# EasyEDA Pro project MushIO_V1p0_Final.eprj, schematic MushIO_V1p0_Final

## Sheets
1 Electrodes: Board Name: MushIO_V1p0_Final; Create Date: 2026-01-24; Page Name: Electrodes; Project Name: MushIO_V1p0_Final; Schematic Name: MushIO_V1p0_Final; Update Date: 2026-01-24; Company: EasyEDA.com; Page Size: A4; Version: V1.0
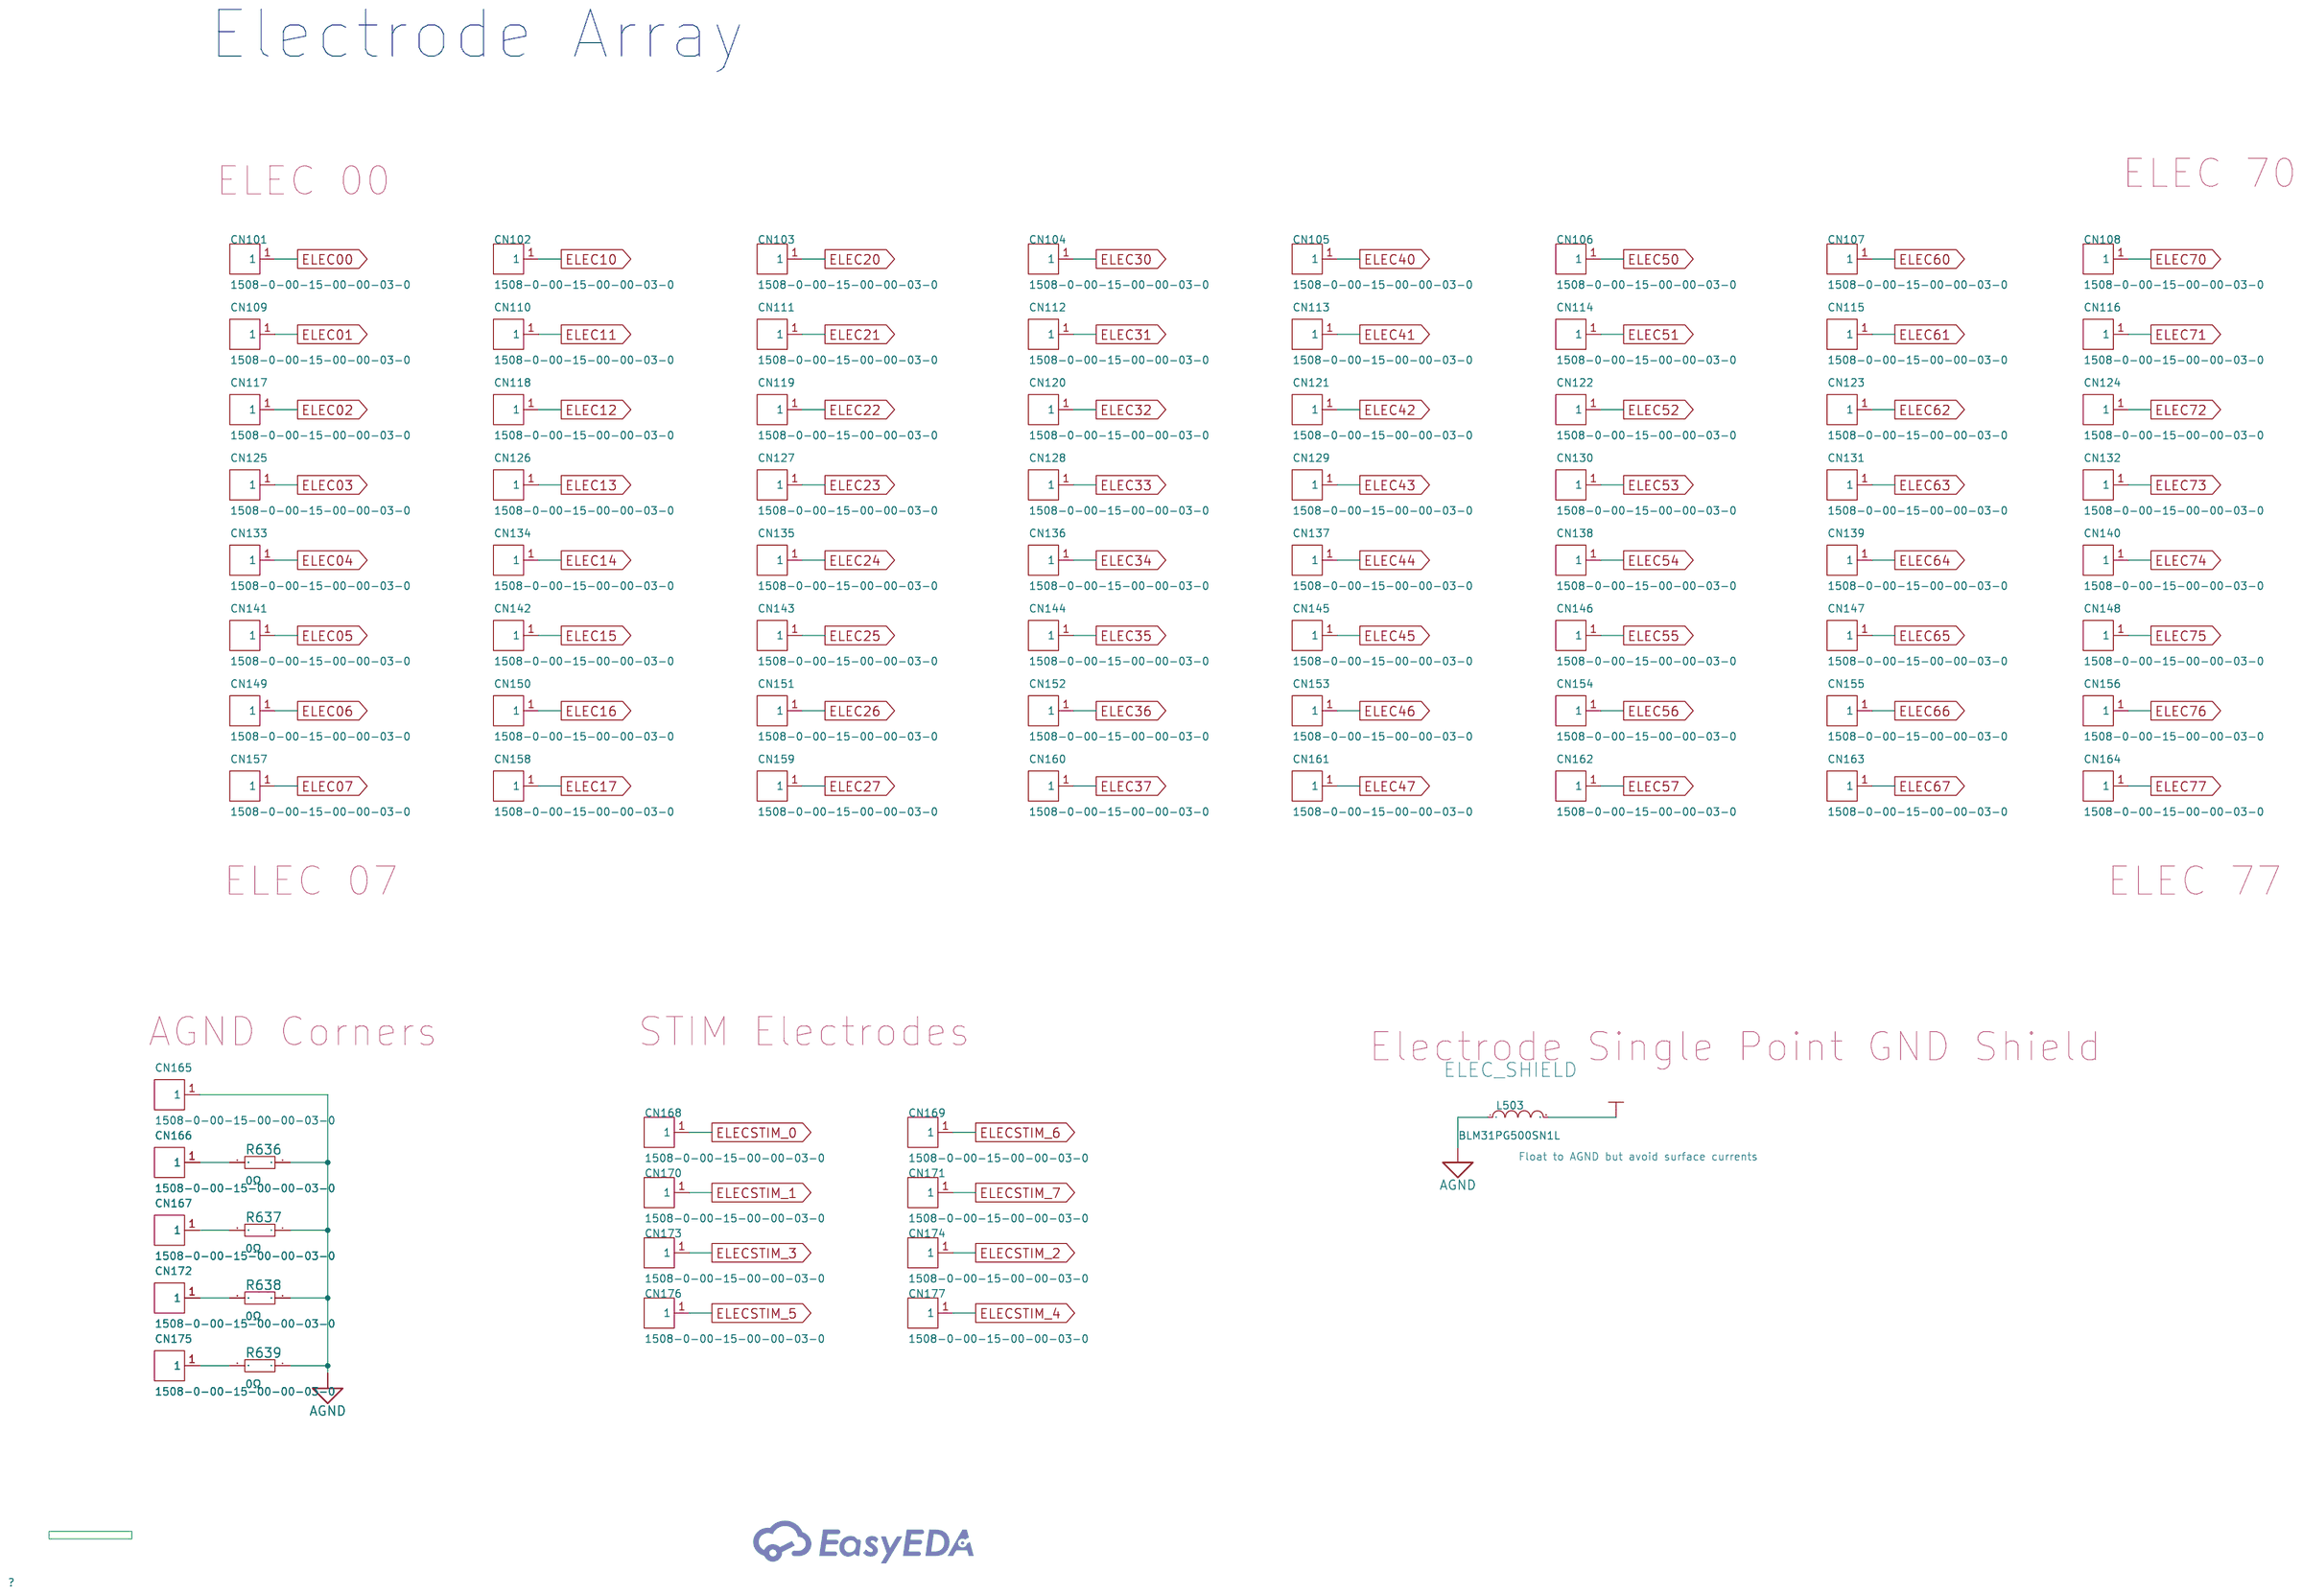
[diagram p2: Electrodes]
2 Power: Page Name: Power; Update Date: 2026-02-10
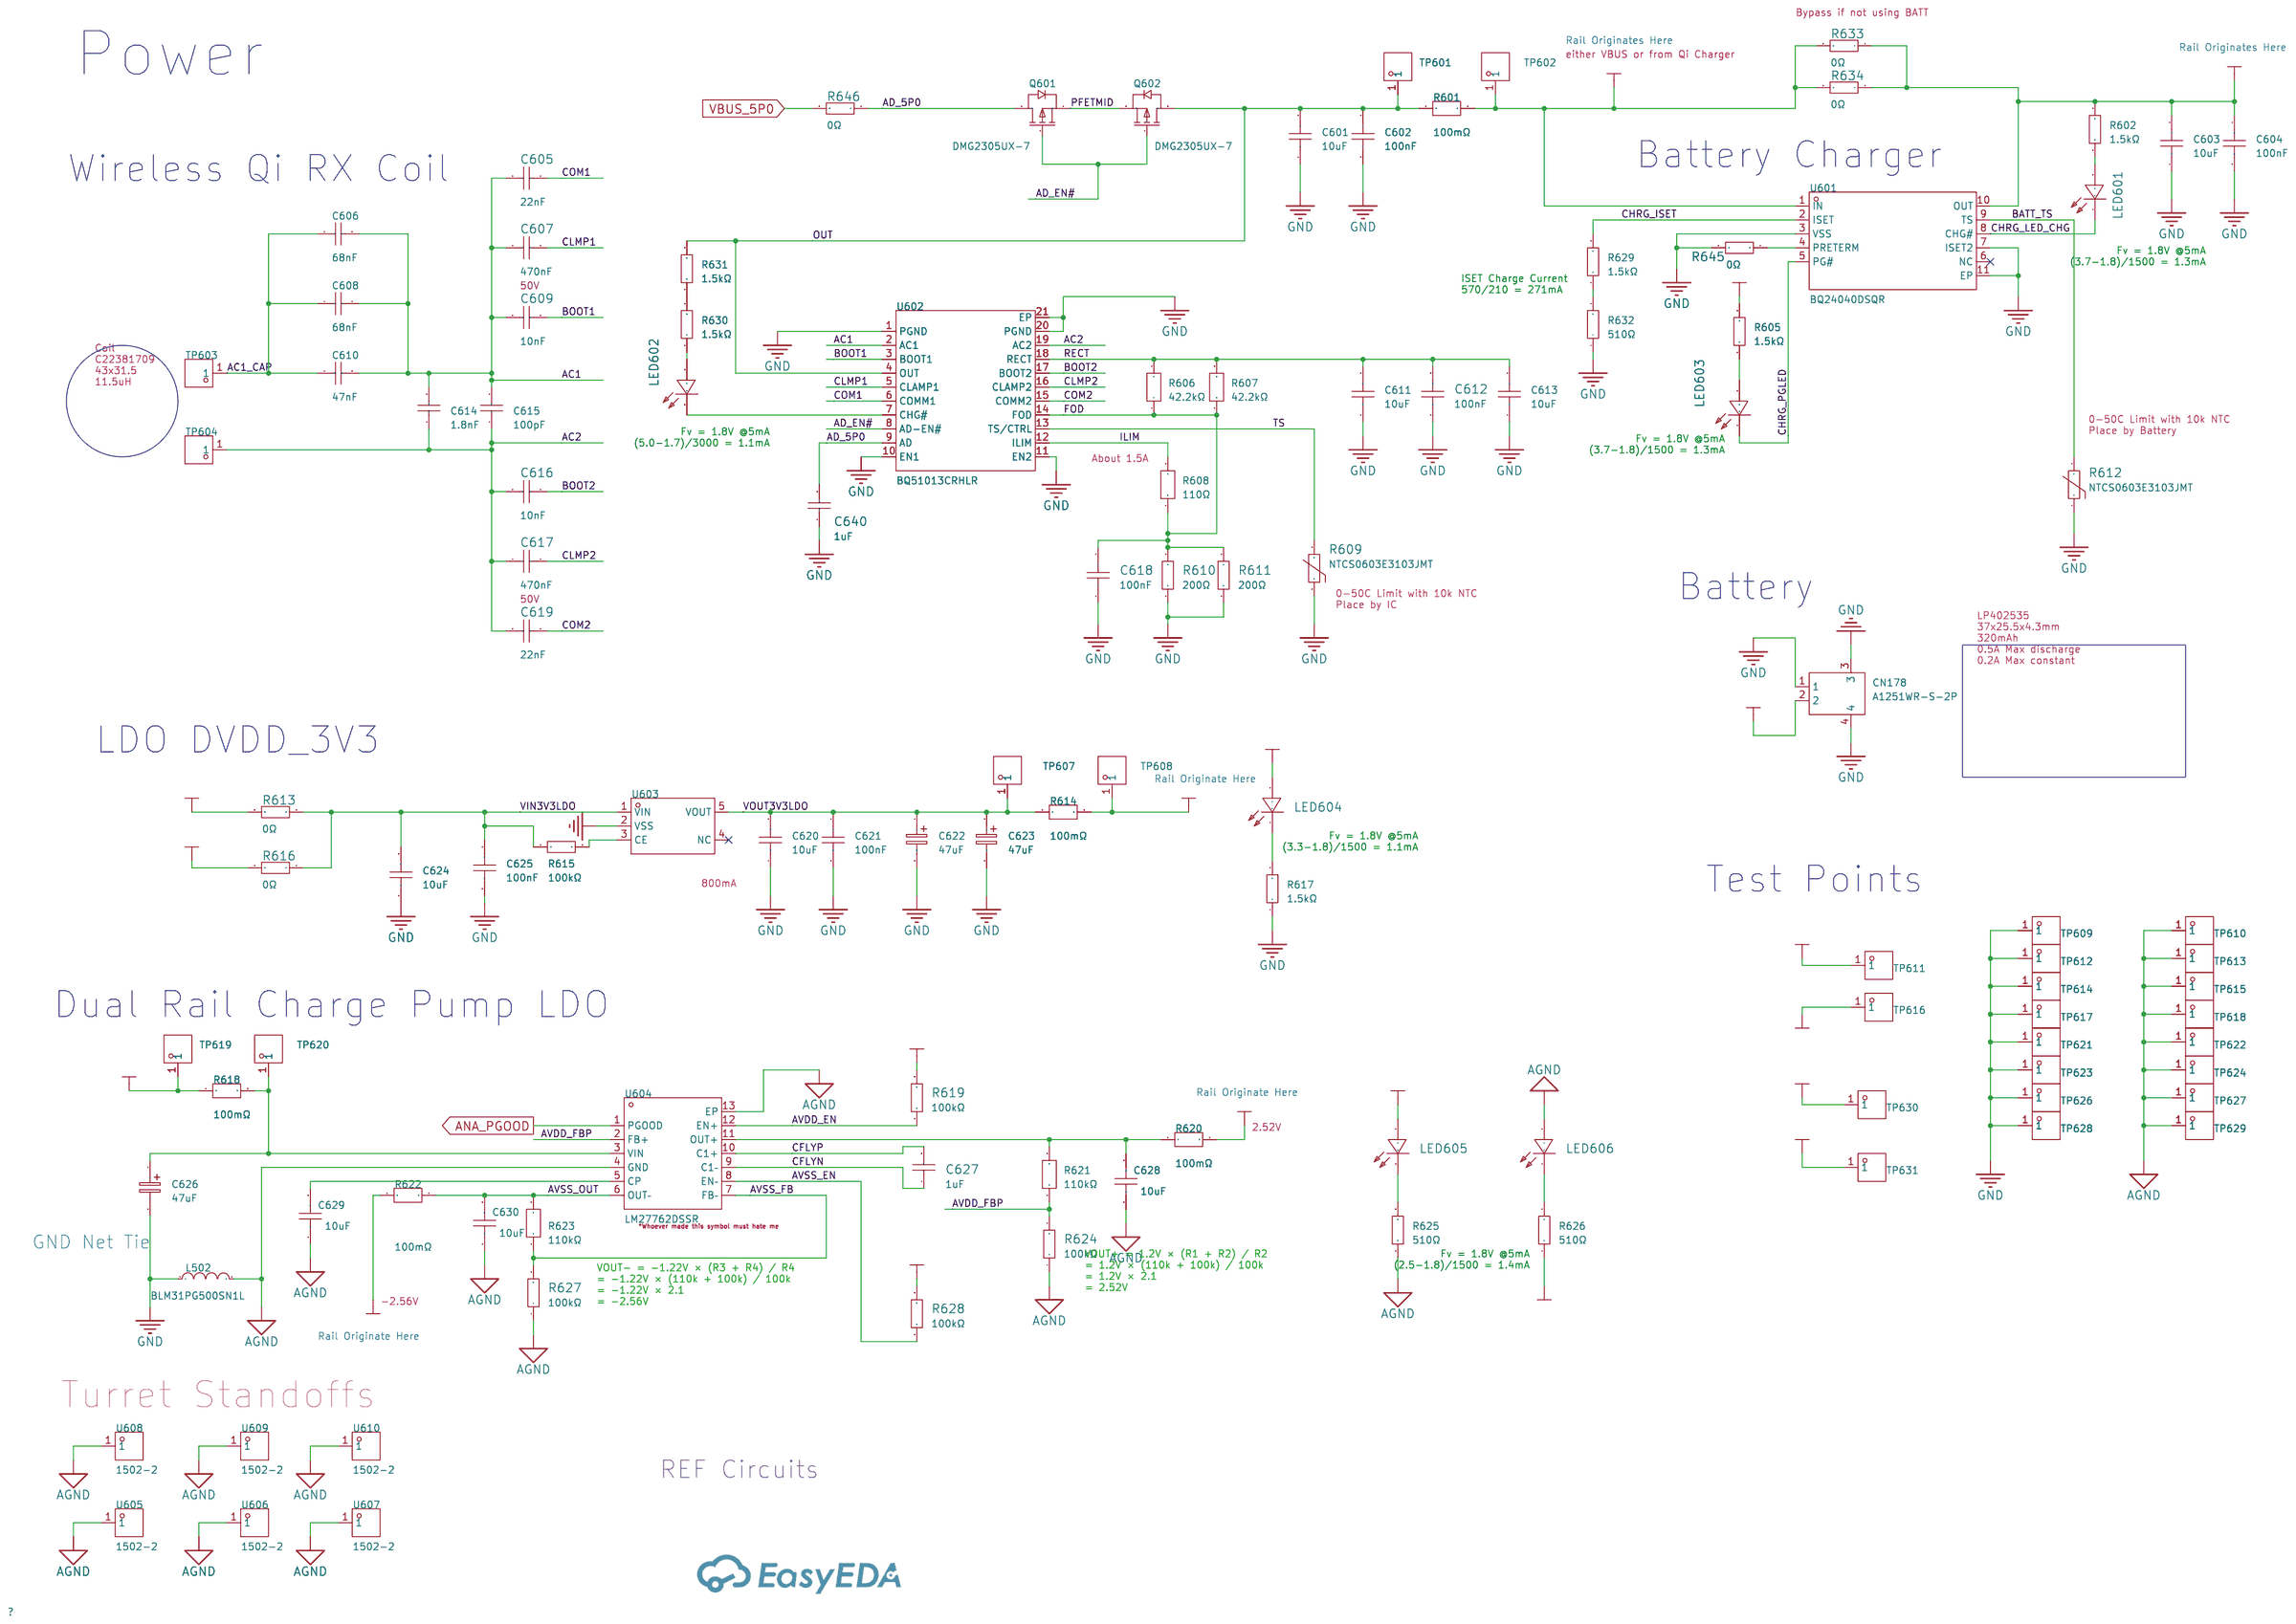
[diagram p3: Power]
3 AFE_ADC01: Board Name: MushIO_V1p2; Create Date: 2025-09-29; Page Name: AFE_ADC01; Project Name: MushIO_V1p2; Schematic Name: MushIO_V1p2; Update Date: 2025-12-31
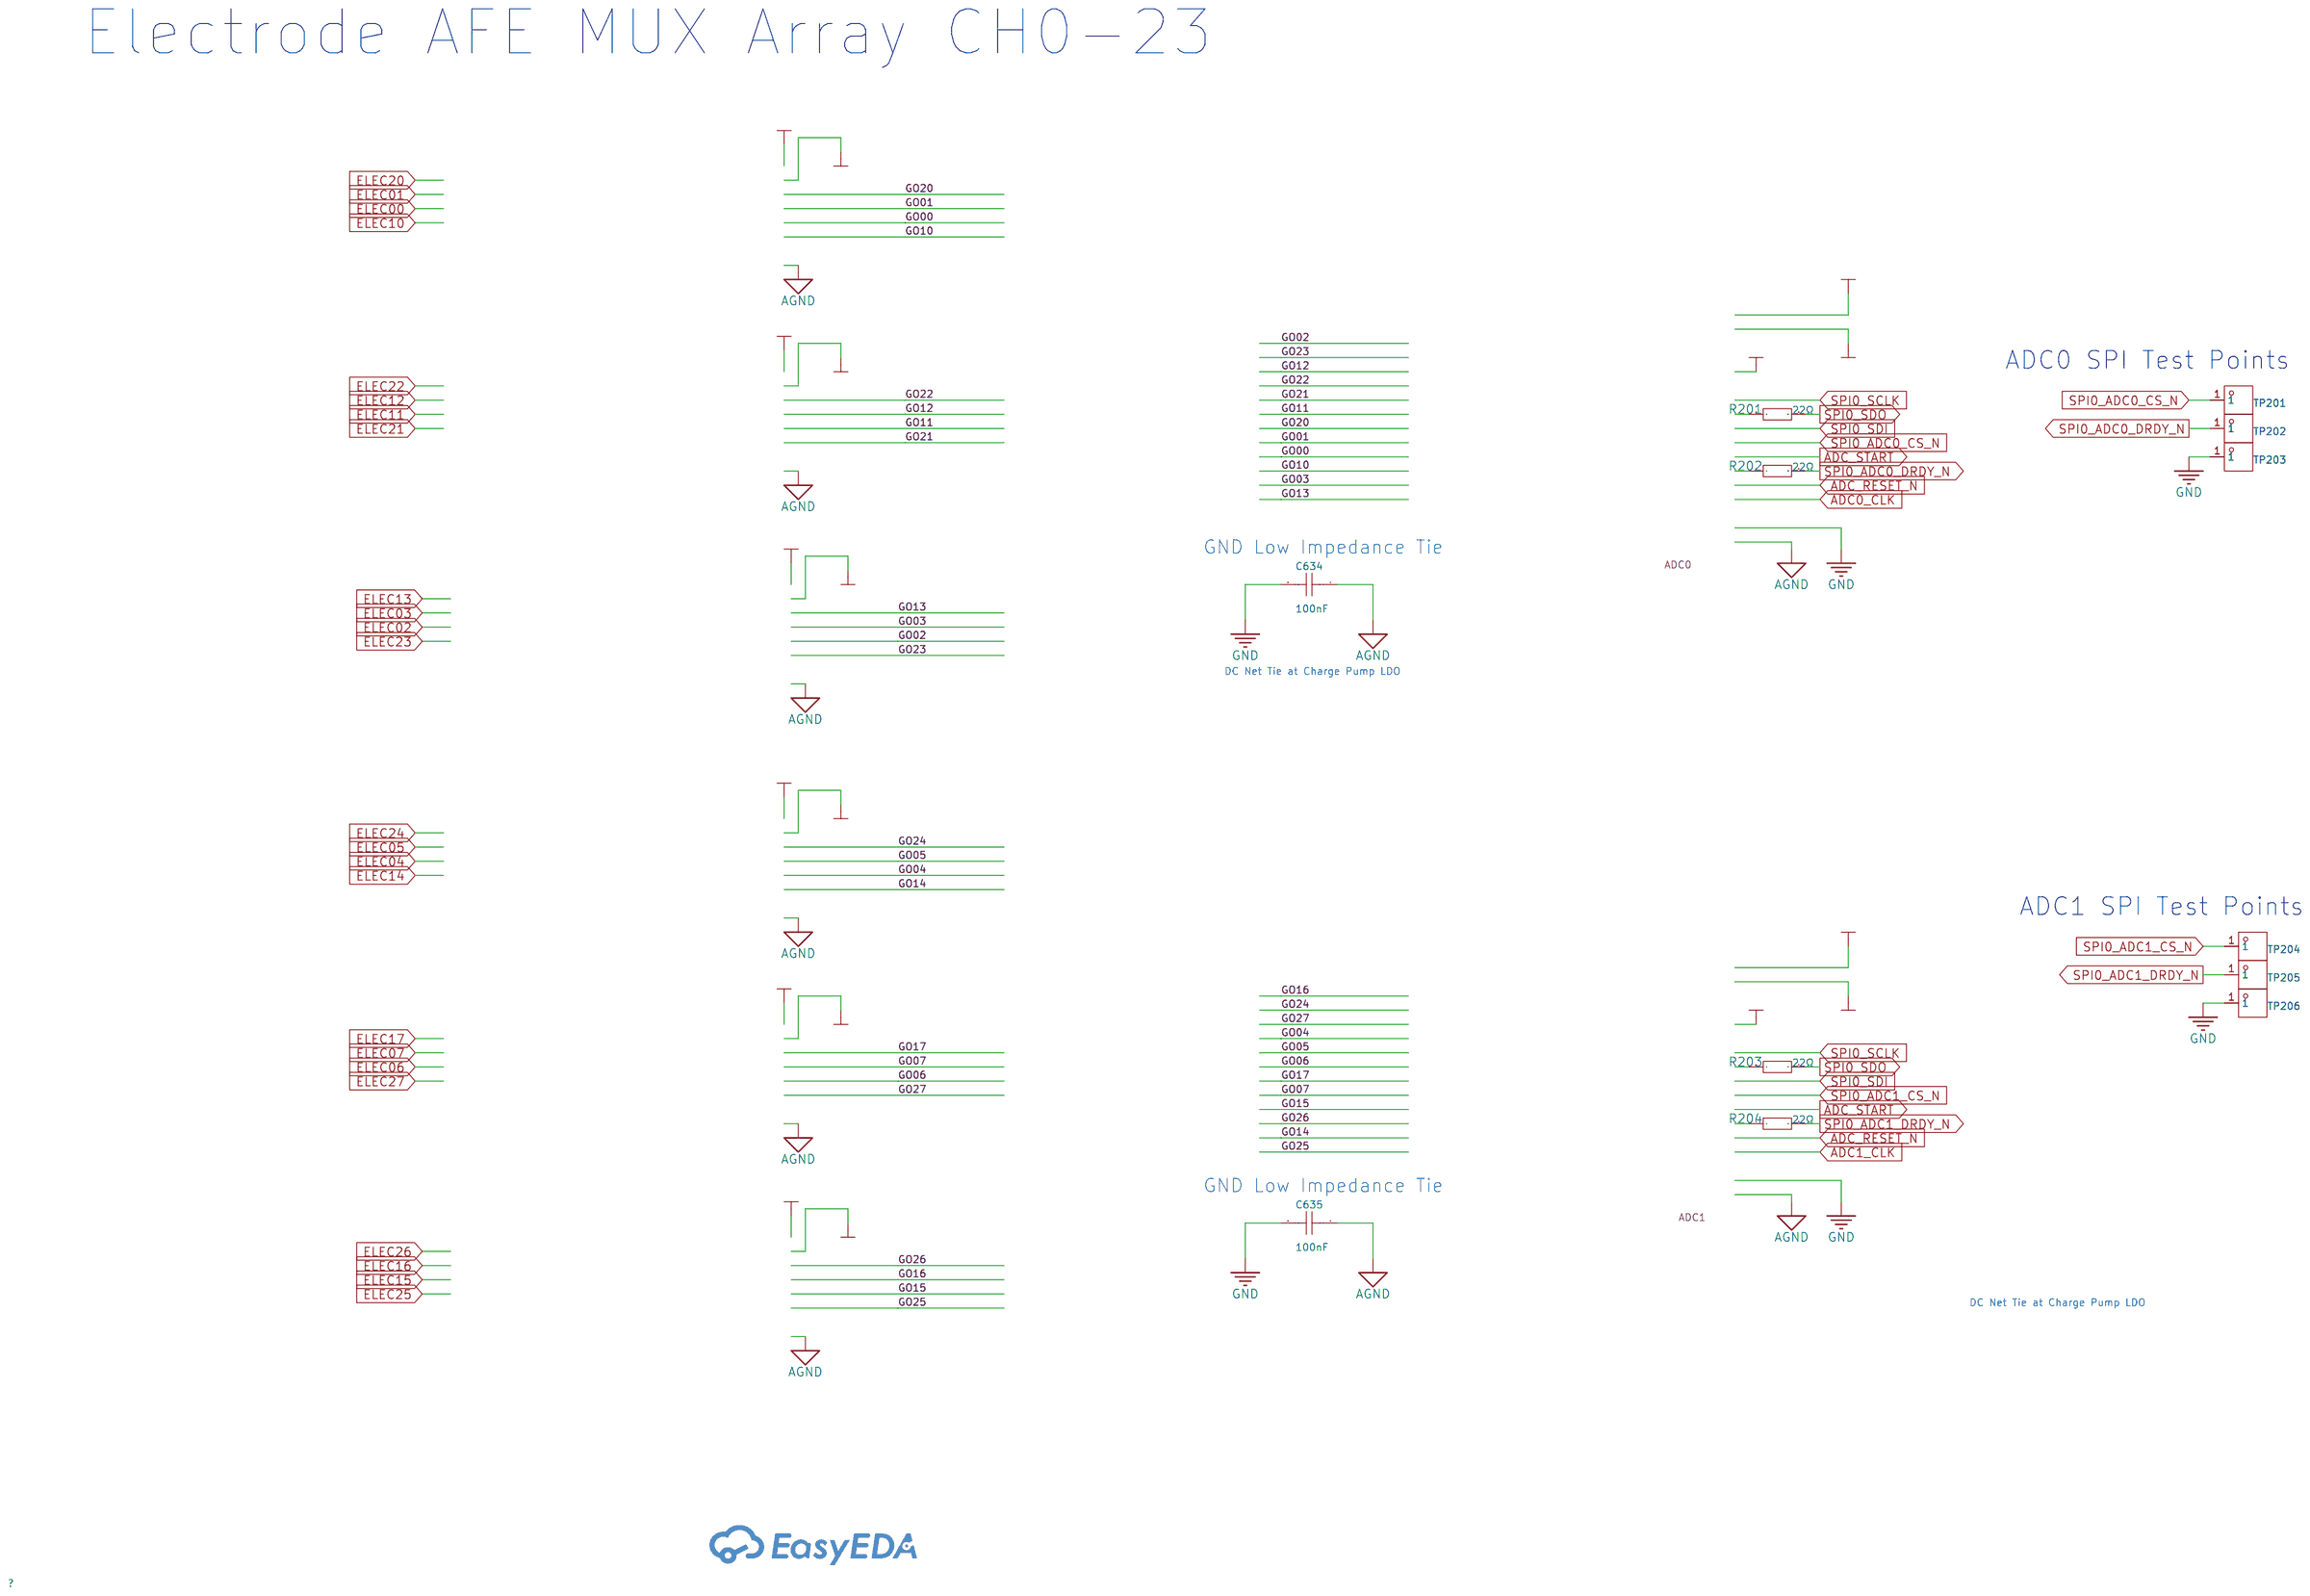
[diagram p4: AFE_ADC01]
4 Calculations: Page Name: Calculations; Update Date: 2026-01-25
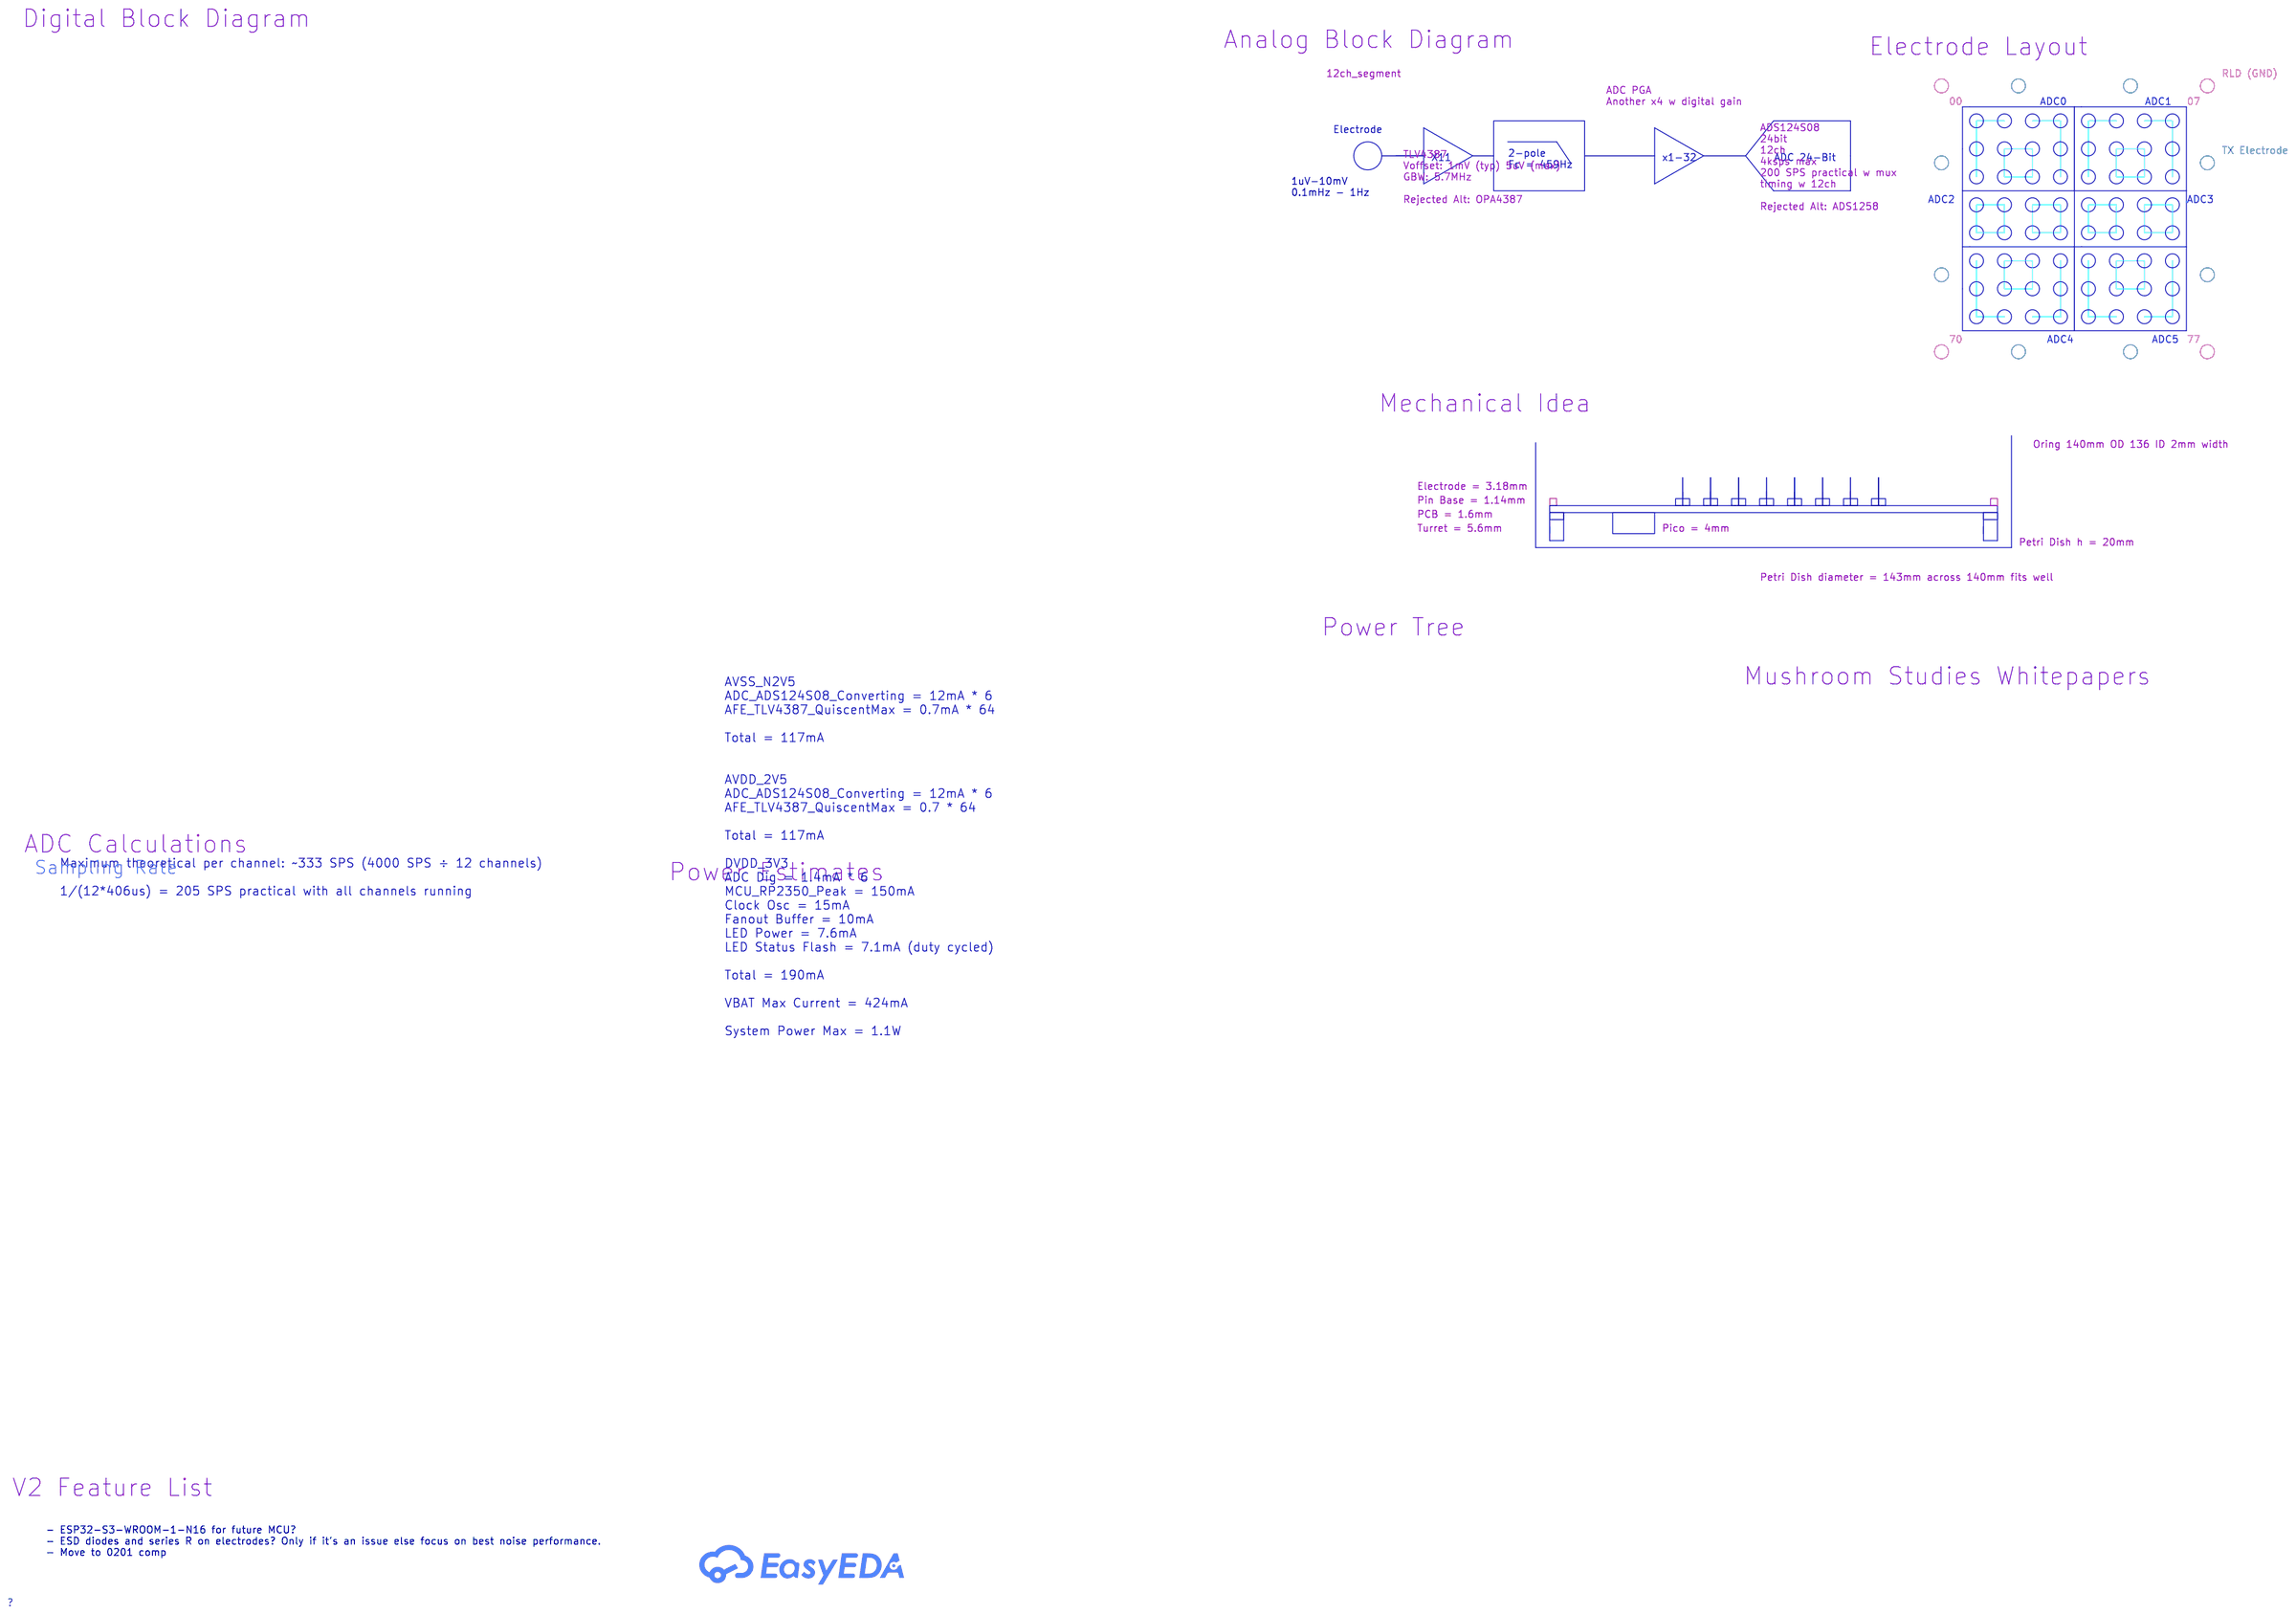
[diagram p5: Calculations]
5 AFE_ADC23: Page Name: AFE_ADC23